# Altium schematic sheet Slot_1.SchDoc: =title_
size 594 x 420 mm; Date: 05/04/2023; CheckedBy: EG; GD; GK; MS; DrawnBy: M. Gąska; DocumentNumber: 4; SheetNumber: 4; SheetTotal: 5; Projet: DI/OT Crate; DivGrp: BE-CO; Title2: Slot 1; Designer: G.Daniluk; CreateDate: 05/04/2023; CheckedDate: 05/04/2023
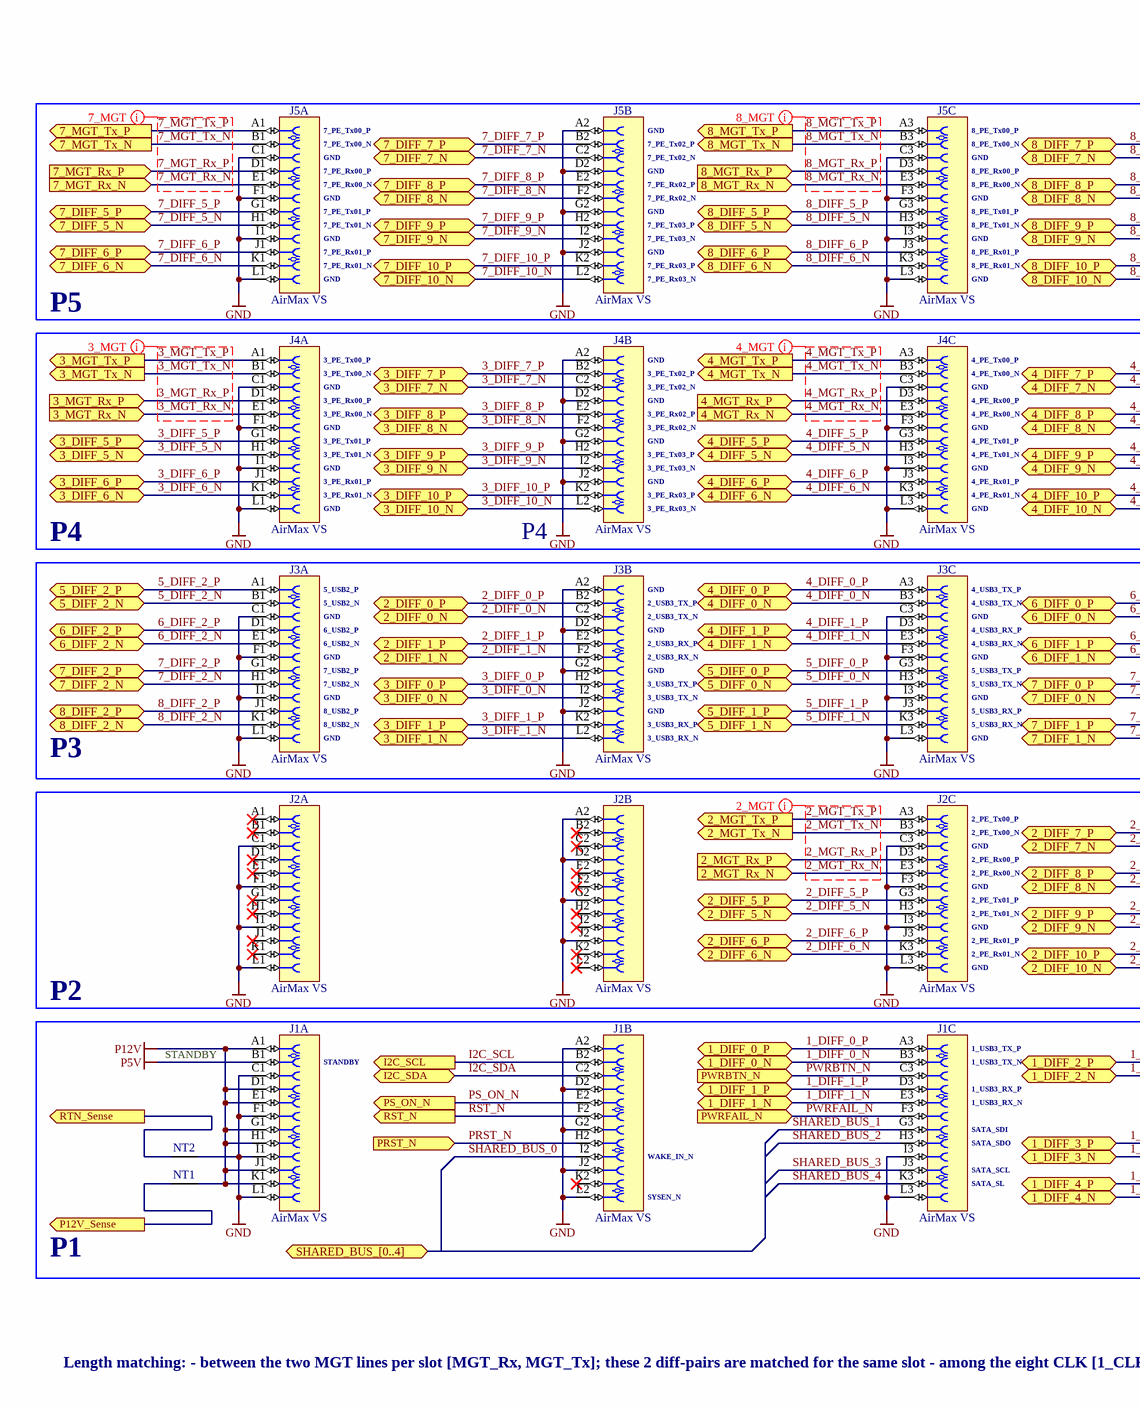
[diagram p0: Slot_1.SchDoc, left]
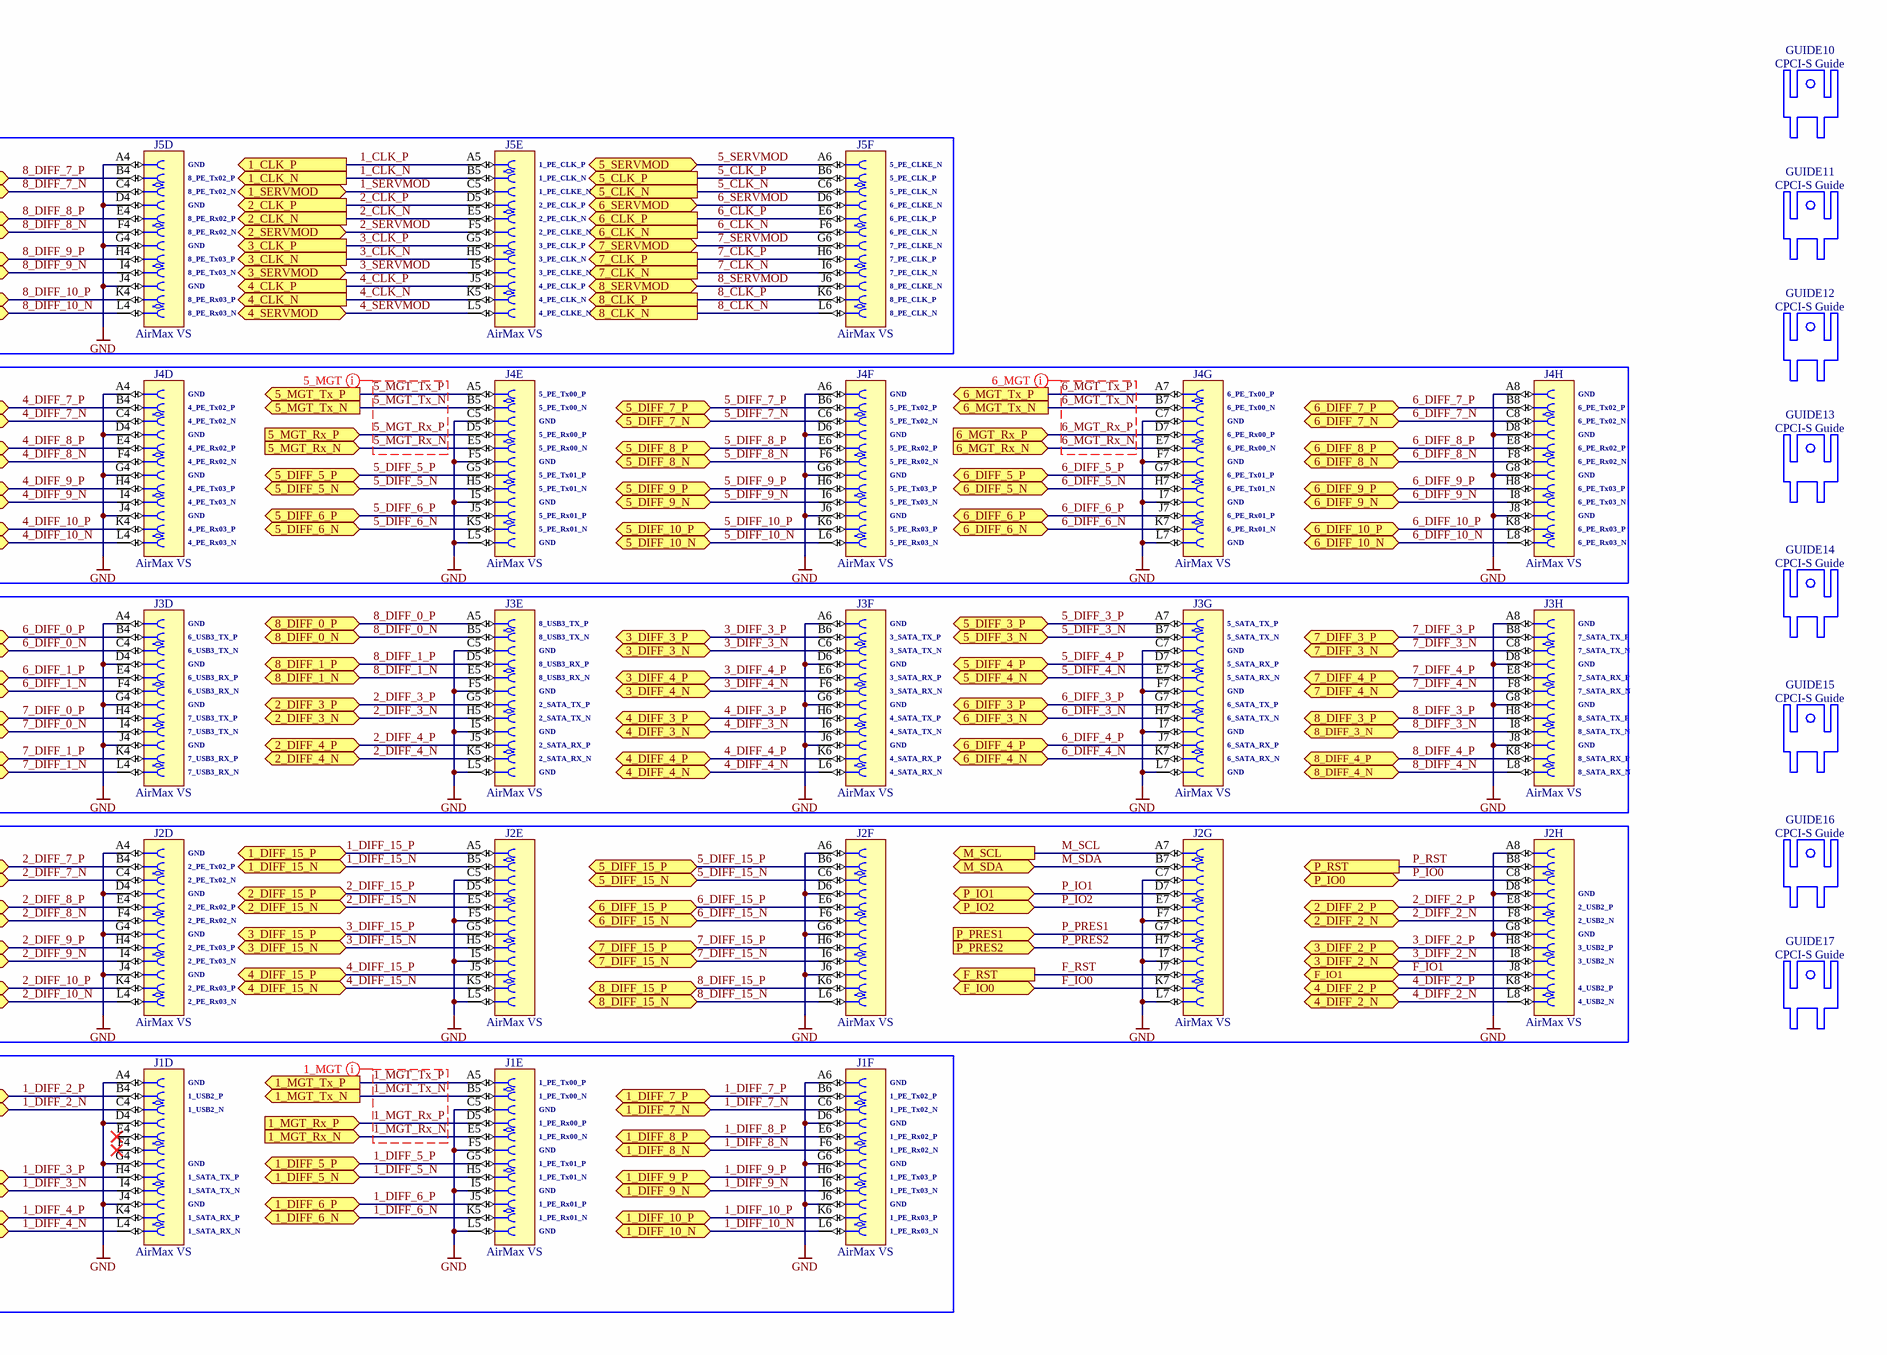
[diagram p1: Slot_1.SchDoc, right]

## Parts
GUIDE10  CPCI-S Guide  [EDA-04126-V1-0]
GUIDE11  CPCI-S Guide  [EDA-04126-V1-0]
GUIDE12  CPCI-S Guide  [EDA-04126-V1-0]
GUIDE13  CPCI-S Guide  [EDA-04126-V1-0]
GUIDE14  CPCI-S Guide  [EDA-04126-V1-0]
GUIDE15  CPCI-S Guide  [EDA-04126-V1-0]
GUIDE16  CPCI-S Guide  [EDA-04126-V1-0]
GUIDE17  CPCI-S Guide  [EDA-04126-V1-0]
J1  AirMax VS  [AMPHENOL_10052829-101LF]  (parts A,B,C,D,E,F of 6)
J2  AirMax VS  [AMPHENOL_10052842-101LF]  (parts A,B,C,D,E,F,G,H of 8)
J3  AirMax VS  [AMPHENOL_10052842-101LF]  (parts A,B,C,D,E,F,G,H of 8)
J4  AirMax VS  [AMPHENOL_10052842-101LF]  (parts A,B,C,D,E,F,G,H of 8)
J5  AirMax VS  [AMPHENOL_10052829-101LF]  (parts A,B,C,D,E,F of 6)
NT1  Net Tie  [Net Tie]  (value not drawn)  (net tie, no BOM)
NT2  Net Tie  [Net Tie]  (value not drawn)  (net tie, no BOM)

## Blocks framed on the sheet
P5: J5
P4: J4
P3: J3
P2: J2

## Ports
1_CLK_N (out), 1_CLK_P (out), 1_DIFF_0_N (bidir), 1_DIFF_0_P (bidir), 1_DIFF_1_N (bidir), 1_DIFF_1_P (bidir), 1_DIFF_2_N (bidir), 1_DIFF_2_P (bidir), 1_DIFF_3_N (bidir), 1_DIFF_3_P (bidir), 1_DIFF_4_N (bidir), 1_DIFF_4_P (bidir), 1_DIFF_5_N (bidir), 1_DIFF_5_P (bidir), 1_DIFF_6_N (bidir), 1_DIFF_6_P (bidir), 1_DIFF_7_N (bidir), 1_DIFF_7_P (bidir), 1_DIFF_8_N (bidir), 1_DIFF_8_P (bidir), 1_DIFF_9_N (bidir), 1_DIFF_9_P (bidir), 1_DIFF_10_N (bidir), 1_DIFF_10_P (bidir), 1_DIFF_15_N (bidir), 1_DIFF_15_P (bidir), 1_MGT_Rx_N (in), 1_MGT_Rx_P (in), 1_MGT_Tx_N (out), 1_MGT_Tx_P (out), 1_SERVMOD (bidir), 2_CLK_N (out), 2_CLK_P (out), 2_DIFF_0_N (bidir), 2_DIFF_0_P (bidir), 2_DIFF_1_N (bidir), 2_DIFF_1_P (bidir), 2_DIFF_2_N (bidir), 2_DIFF_2_P (bidir), 2_DIFF_3_N (bidir), 2_DIFF_3_P (bidir), 2_DIFF_4_N (bidir), 2_DIFF_4_P (bidir), 2_DIFF_5_N (bidir), 2_DIFF_5_P (bidir), 2_DIFF_6_N (bidir), 2_DIFF_6_P (bidir), 2_DIFF_7_N (bidir), 2_DIFF_7_P (bidir), 2_DIFF_8_N (bidir), 2_DIFF_8_P (bidir), 2_DIFF_9_N (bidir), 2_DIFF_9_P (bidir), 2_DIFF_10_N (bidir), 2_DIFF_10_P (bidir), 2_DIFF_15_N (bidir), 2_DIFF_15_P (bidir), 2_MGT_Rx_N (in), 2_MGT_Rx_P (in), 2_MGT_Tx_N (out), 2_MGT_Tx_P (out), 2_SERVMOD (bidir), 3_CLK_N (out), 3_CLK_P (out), 3_DIFF_0_N (bidir), 3_DIFF_0_P (bidir), 3_DIFF_1_N (bidir), 3_DIFF_1_P (bidir), 3_DIFF_2_N (bidir), 3_DIFF_2_P (bidir), 3_DIFF_3_N (bidir), 3_DIFF_3_P (bidir), 3_DIFF_4_N (bidir), 3_DIFF_4_P (bidir), 3_DIFF_5_N (bidir), 3_DIFF_5_P (bidir), 3_DIFF_6_N (bidir), 3_DIFF_6_P (bidir), 3_DIFF_7_N (bidir), 3_DIFF_7_P (bidir), 3_DIFF_8_N (bidir), 3_DIFF_8_P (bidir), 3_DIFF_9_N (bidir), 3_DIFF_9_P (bidir), 3_DIFF_10_N (bidir), 3_DIFF_10_P (bidir), 3_DIFF_15_N (bidir), 3_DIFF_15_P (bidir), 3_MGT_Rx_N (in), 3_MGT_Rx_P (in), 3_MGT_Tx_N (out), 3_MGT_Tx_P (out), 3_SERVMOD (bidir), 4_CLK_N (out), 4_CLK_P (out), 4_DIFF_0_N (bidir), 4_DIFF_0_P (bidir), 4_DIFF_1_N (bidir), 4_DIFF_1_P (bidir), 4_DIFF_2_N (bidir), 4_DIFF_2_P (bidir), 4_DIFF_3_N (bidir), 4_DIFF_3_P (bidir), 4_DIFF_4_N (bidir), 4_DIFF_4_P (bidir), 4_DIFF_5_N (bidir), 4_DIFF_5_P (bidir), 4_DIFF_6_N (bidir), 4_DIFF_6_P (bidir), 4_DIFF_7_N (bidir), 4_DIFF_7_P (bidir), 4_DIFF_8_N (bidir), 4_DIFF_8_P (bidir), 4_DIFF_9_N (bidir), 4_DIFF_9_P (bidir), 4_DIFF_10_N (bidir), 4_DIFF_10_P (bidir), 4_DIFF_15_N (bidir), 4_DIFF_15_P (bidir), 4_MGT_Rx_N (in), 4_MGT_Rx_P (in), 4_MGT_Tx_N (out), 4_MGT_Tx_P (out), 4_SERVMOD (bidir), 5_CLK_N (out), 5_CLK_P (out), 5_DIFF_0_N (bidir), 5_DIFF_0_P (bidir), 5_DIFF_1_N (bidir), 5_DIFF_1_P (bidir), 5_DIFF_2_N (bidir), 5_DIFF_2_P (bidir), 5_DIFF_3_N (bidir), 5_DIFF_3_P (bidir), 5_DIFF_4_N (bidir), 5_DIFF_4_P (bidir), 5_DIFF_5_N (bidir), 5_DIFF_5_P (bidir), 5_DIFF_6_N (bidir), 5_DIFF_6_P (bidir), 5_DIFF_7_N (bidir), 5_DIFF_7_P (bidir), 5_DIFF_8_N (bidir), 5_DIFF_8_P (bidir), 5_DIFF_9_N (bidir), 5_DIFF_9_P (bidir), 5_DIFF_10_N (bidir), 5_DIFF_10_P (bidir), 5_DIFF_15_N (bidir), 5_DIFF_15_P (bidir), 5_MGT_Rx_N (in), 5_MGT_Rx_P (in), 5_MGT_Tx_N (out), 5_MGT_Tx_P (out), 5_SERVMOD (bidir), 6_CLK_N (out), 6_CLK_P (out), 6_DIFF_0_N (bidir), 6_DIFF_0_P (bidir), 6_DIFF_1_N (bidir), 6_DIFF_1_P (bidir), 6_DIFF_2_N (bidir), 6_DIFF_2_P (bidir), 6_DIFF_3_N (bidir), 6_DIFF_3_P (bidir), 6_DIFF_4_N (bidir), 6_DIFF_4_P (bidir), 6_DIFF_5_N (bidir), 6_DIFF_5_P (bidir), 6_DIFF_6_N (bidir), 6_DIFF_6_P (bidir), 6_DIFF_7_N (bidir), 6_DIFF_7_P (bidir), 6_DIFF_8_N (bidir), 6_DIFF_8_P (bidir), 6_DIFF_9_N (bidir), 6_DIFF_9_P (bidir), 6_DIFF_10_N (bidir), 6_DIFF_10_P (bidir), 6_DIFF_15_N (bidir), 6_DIFF_15_P (bidir), 6_MGT_Rx_N (in), 6_MGT_Rx_P (in), 6_MGT_Tx_N (out), 6_MGT_Tx_P (out), 6_SERVMOD (bidir), 7_CLK_N (out), 7_CLK_P (out), 7_DIFF_0_N (bidir), 7_DIFF_0_P (bidir), 7_DIFF_1_N (bidir), 7_DIFF_1_P (bidir), 7_DIFF_2_N (bidir), 7_DIFF_2_P (bidir), 7_DIFF_3_N (bidir), 7_DIFF_3_P (bidir), 7_DIFF_4_N (bidir), 7_DIFF_4_P (bidir), 7_DIFF_5_N (bidir), 7_DIFF_5_P (bidir), 7_DIFF_6_N (bidir), 7_DIFF_6_P (bidir), 7_DIFF_7_N (bidir), 7_DIFF_7_P (bidir), 7_DIFF_8_N (bidir), 7_DIFF_8_P (bidir), 7_DIFF_9_N (bidir), 7_DIFF_9_P (bidir), 7_DIFF_10_N (bidir), 7_DIFF_10_P (bidir), 7_DIFF_15_N (bidir), 7_DIFF_15_P (bidir), 7_MGT_Rx_N (in), 7_MGT_Rx_P (in), 7_MGT_Tx_N (out), 7_MGT_Tx_P (out), 7_SERVMOD (bidir), 8_CLK_N (out), 8_CLK_P (out), 8_DIFF_0_N (bidir), 8_DIFF_0_P (bidir), 8_DIFF_1_N (bidir), 8_DIFF_1_P (bidir), 8_DIFF_2_N (bidir), 8_DIFF_2_P (bidir), 8_DIFF_3_N (bidir), 8_DIFF_3_P (bidir), 8_DIFF_4_N (bidir), 8_DIFF_4_P (bidir), 8_DIFF_5_N (bidir), 8_DIFF_5_P (bidir), 8_DIFF_6_N (bidir), 8_DIFF_6_P (bidir), 8_DIFF_7_N (bidir), 8_DIFF_7_P (bidir), 8_DIFF_8_N (bidir), 8_DIFF_8_P (bidir), 8_DIFF_9_N (bidir), 8_DIFF_9_P (bidir), 8_DIFF_10_N (bidir), 8_DIFF_10_P (bidir), 8_DIFF_15_N (bidir), 8_DIFF_15_P (bidir), 8_MGT_Rx_N (in), 8_MGT_Rx_P (in), 8_MGT_Tx_N (out), 8_MGT_Tx_P (out), 8_SERVMOD (bidir), F_IO0 (bidir), F_IO1 (bidir), F_RST (out), I2C_SCL (out), I2C_SDA (bidir), M_SCL (out), M_SDA (bidir), P12V_Sense (out), P_IO0 (bidir), P_IO1 (bidir), P_IO2 (bidir), P_PRES1 (in), P_PRES2 (in), P_RST (out), PRST_N (in), PS_ON_N (out), PWRBTN_N (in), PWRFAIL_N (in), RST_N (out), RTN_Sense (out), SHARED_BUS_[0..4] (bidir)

## Nets
GND: J1.A2 J1.A4 J1.A6 J1.C1 J1.C5 J1.D2 J1.D4 J1.D6 J1.F1 J1.F5 J1.G2 J1.G4 J1.G6 J1.I1 J1.I3 J1.I5 J1.J2 J1.J4 J1.J6 J1.L1 J1.L2 J1.L3 J1.L5 J2.A2 J2.A4 J2.A6 J2.A8 J2.C1 J2.C3 J2.C5 J2.C7 J2.D2 J2.D4 J2.D6 J2.D8 J2.F1 J2.F3 J2.F5 J2.F7 J2.G2 J2.G4 J2.G6 J2.G8 J2.I1 J2.I3 J2.I5 J2.I7 J2.J2 J2.J4 J2.J6 J2.L1 J2.L3 J2.L5 J2.L7 J3.A2 J3.A4 J3.A6 J3.A8 J3.C1 J3.C3 J3.C5 J3.C7 J3.D2 J3.D4 J3.D6 J3.D8 J3.F1 J3.F3 J3.F5 J3.F7 J3.G2 J3.G4 J3.G6 J3.G8 J3.I1 J3.I3 J3.I5 J3.I7 J3.J2 J3.J4 J3.J6 J3.J8 J3.L1 J3.L3 J3.L5 J3.L7 J4.A2 J4.A4 J4.A6 J4.A8 J4.C1 J4.C3 J4.C5 J4.C7 J4.D2 J4.D4 J4.D6 J4.D8 J4.F1 J4.F3 J4.F5 J4.F7 J4.G2 J4.G4 J4.G6 J4.G8 J4.I1 J4.I3 J4.I5 J4.I7 J4.J2 J4.J4 J4.J6 J4.J8 J4.L1 J4.L3 J4.L5 J4.L7 J5.A2 J5.A4 J5.C1 J5.C3 J5.D2 J5.D4 J5.F1 J5.F3 J5.G2 J5.G4 J5.I1 J5.I3 J5.J2 J5.J4 J5.L1 J5.L3 NT2.2
P5V: J1.B1
P12V: J1.A1 J1.D1 J1.E1 J1.G1 J1.H1 J1.J1 J1.K1 NT1.2
1_CLK_N: J5.B5 ; port 1_CLK_N
1_CLK_P: J5.A5 ; port 1_CLK_P
1_DIFF_0_N: J1.B3 ; port 1_DIFF_0_N
1_DIFF_0_P: J1.A3 ; port 1_DIFF_0_P
1_DIFF_1_N: J1.E3 ; port 1_DIFF_1_N
1_DIFF_1_P: J1.D3 ; port 1_DIFF_1_P
1_DIFF_2_N: J1.C4 ; port 1_DIFF_2_N
1_DIFF_2_P: J1.B4 ; port 1_DIFF_2_P
1_DIFF_3_N: J1.I4 ; port 1_DIFF_3_N
1_DIFF_3_P: J1.H4 ; port 1_DIFF_3_P
1_DIFF_4_N: J1.L4 ; port 1_DIFF_4_N
1_DIFF_4_P: J1.K4 ; port 1_DIFF_4_P
1_DIFF_5_N: J1.H5 ; port 1_DIFF_5_N
1_DIFF_5_P: J1.G5 ; port 1_DIFF_5_P
1_DIFF_6_N: J1.K5 ; port 1_DIFF_6_N
1_DIFF_6_P: J1.J5 ; port 1_DIFF_6_P
1_DIFF_7_N: J1.C6 ; port 1_DIFF_7_N
1_DIFF_7_P: J1.B6 ; port 1_DIFF_7_P
1_DIFF_8_N: J1.F6 ; port 1_DIFF_8_N
1_DIFF_8_P: J1.E6 ; port 1_DIFF_8_P
1_DIFF_9_N: J1.I6 ; port 1_DIFF_9_N
1_DIFF_9_P: J1.H6 ; port 1_DIFF_9_P
1_DIFF_10_N: J1.L6 ; port 1_DIFF_10_N
1_DIFF_10_P: J1.K6 ; port 1_DIFF_10_P
1_DIFF_15_N: J2.B5 ; port 1_DIFF_15_N
1_DIFF_15_P: J2.A5 ; port 1_DIFF_15_P
1_MGT_Rx_N: J1.E5 ; port 1_MGT_Rx_N
1_MGT_Rx_P: J1.D5 ; port 1_MGT_Rx_P
1_MGT_Tx_N: J1.B5 ; port 1_MGT_Tx_N
1_MGT_Tx_P: J1.A5 ; port 1_MGT_Tx_P
1_SERVMOD: J5.C5 ; port 1_SERVMOD
2_CLK_N: J5.E5 ; port 2_CLK_N
2_CLK_P: J5.D5 ; port 2_CLK_P
2_DIFF_0_N: J3.C2 ; port 2_DIFF_0_N
2_DIFF_0_P: J3.B2 ; port 2_DIFF_0_P
2_DIFF_1_N: J3.F2 ; port 2_DIFF_1_N
2_DIFF_1_P: J3.E2 ; port 2_DIFF_1_P
2_DIFF_2_N: J2.F8 ; port 2_DIFF_2_N
2_DIFF_2_P: J2.E8 ; port 2_DIFF_2_P
2_DIFF_3_N: J3.H5 ; port 2_DIFF_3_N
2_DIFF_3_P: J3.G5 ; port 2_DIFF_3_P
2_DIFF_4_N: J3.K5 ; port 2_DIFF_4_N
2_DIFF_4_P: J3.J5 ; port 2_DIFF_4_P
2_DIFF_5_N: J2.H3 ; port 2_DIFF_5_N
2_DIFF_5_P: J2.G3 ; port 2_DIFF_5_P
2_DIFF_6_N: J2.K3 ; port 2_DIFF_6_N
2_DIFF_6_P: J2.J3 ; port 2_DIFF_6_P
2_DIFF_7_N: J2.C4 ; port 2_DIFF_7_N
2_DIFF_7_P: J2.B4 ; port 2_DIFF_7_P
2_DIFF_8_N: J2.F4 ; port 2_DIFF_8_N
2_DIFF_8_P: J2.E4 ; port 2_DIFF_8_P
2_DIFF_9_N: J2.I4 ; port 2_DIFF_9_N
2_DIFF_9_P: J2.H4 ; port 2_DIFF_9_P
2_DIFF_10_N: J2.L4 ; port 2_DIFF_10_N
2_DIFF_10_P: J2.K4 ; port 2_DIFF_10_P
2_DIFF_15_N: J2.E5 ; port 2_DIFF_15_N
2_DIFF_15_P: J2.D5 ; port 2_DIFF_15_P
2_MGT_Rx_N: J2.E3 ; port 2_MGT_Rx_N
2_MGT_Rx_P: J2.D3 ; port 2_MGT_Rx_P
2_MGT_Tx_N: J2.B3 ; port 2_MGT_Tx_N
2_MGT_Tx_P: J2.A3 ; port 2_MGT_Tx_P
2_SERVMOD: J5.F5 ; port 2_SERVMOD
3_CLK_N: J5.H5 ; port 3_CLK_N
3_CLK_P: J5.G5 ; port 3_CLK_P
3_DIFF_0_N: J3.I2 ; port 3_DIFF_0_N
3_DIFF_0_P: J3.H2 ; port 3_DIFF_0_P
3_DIFF_1_N: J3.L2 ; port 3_DIFF_1_N
3_DIFF_1_P: J3.K2 ; port 3_DIFF_1_P
3_DIFF_2_N: J2.I8 ; port 3_DIFF_2_N
3_DIFF_2_P: J2.H8 ; port 3_DIFF_2_P
3_DIFF_3_N: J3.C6 ; port 3_DIFF_3_N
3_DIFF_3_P: J3.B6 ; port 3_DIFF_3_P
3_DIFF_4_N: J3.F6 ; port 3_DIFF_4_N
3_DIFF_4_P: J3.E6 ; port 3_DIFF_4_P
3_DIFF_5_N: J4.H1 ; port 3_DIFF_5_N
3_DIFF_5_P: J4.G1 ; port 3_DIFF_5_P
3_DIFF_6_N: J4.K1 ; port 3_DIFF_6_N
3_DIFF_6_P: J4.J1 ; port 3_DIFF_6_P
3_DIFF_7_N: J4.C2 ; port 3_DIFF_7_N
3_DIFF_7_P: J4.B2 ; port 3_DIFF_7_P
3_DIFF_8_N: J4.F2 ; port 3_DIFF_8_N
3_DIFF_8_P: J4.E2 ; port 3_DIFF_8_P
3_DIFF_9_N: J4.I2 ; port 3_DIFF_9_N
3_DIFF_9_P: J4.H2 ; port 3_DIFF_9_P
3_DIFF_10_N: J4.L2 ; port 3_DIFF_10_N
3_DIFF_10_P: J4.K2 ; port 3_DIFF_10_P
3_DIFF_15_N: J2.H5 ; port 3_DIFF_15_N
3_DIFF_15_P: J2.G5 ; port 3_DIFF_15_P
3_MGT_Rx_N: J4.E1 ; port 3_MGT_Rx_N
3_MGT_Rx_P: J4.D1 ; port 3_MGT_Rx_P
3_MGT_Tx_N: J4.B1 ; port 3_MGT_Tx_N
3_MGT_Tx_P: J4.A1 ; port 3_MGT_Tx_P
3_SERVMOD: J5.I5 ; port 3_SERVMOD
4_CLK_N: J5.K5 ; port 4_CLK_N
4_CLK_P: J5.J5 ; port 4_CLK_P
4_DIFF_0_N: J3.B3 ; port 4_DIFF_0_N
4_DIFF_0_P: J3.A3 ; port 4_DIFF_0_P
4_DIFF_1_N: J3.E3 ; port 4_DIFF_1_N
4_DIFF_1_P: J3.D3 ; port 4_DIFF_1_P
4_DIFF_2_N: J2.L8 ; port 4_DIFF_2_N
4_DIFF_2_P: J2.K8 ; port 4_DIFF_2_P
4_DIFF_3_N: J3.I6 ; port 4_DIFF_3_N
4_DIFF_3_P: J3.H6 ; port 4_DIFF_3_P
4_DIFF_4_N: J3.L6 ; port 4_DIFF_4_N
4_DIFF_4_P: J3.K6 ; port 4_DIFF_4_P
4_DIFF_5_N: J4.H3 ; port 4_DIFF_5_N
4_DIFF_5_P: J4.G3 ; port 4_DIFF_5_P
4_DIFF_6_N: J4.K3 ; port 4_DIFF_6_N
4_DIFF_6_P: J4.J3 ; port 4_DIFF_6_P
4_DIFF_7_N: J4.C4 ; port 4_DIFF_7_N
4_DIFF_7_P: J4.B4 ; port 4_DIFF_7_P
4_DIFF_8_N: J4.F4 ; port 4_DIFF_8_N
4_DIFF_8_P: J4.E4 ; port 4_DIFF_8_P
4_DIFF_9_N: J4.I4 ; port 4_DIFF_9_N
4_DIFF_9_P: J4.H4 ; port 4_DIFF_9_P
4_DIFF_10_N: J4.L4 ; port 4_DIFF_10_N
4_DIFF_10_P: J4.K4 ; port 4_DIFF_10_P
4_DIFF_15_N: J2.K5 ; port 4_DIFF_15_N
4_DIFF_15_P: J2.J5 ; port 4_DIFF_15_P
4_MGT_Rx_N: J4.E3 ; port 4_MGT_Rx_N
4_MGT_Rx_P: J4.D3 ; port 4_MGT_Rx_P
4_MGT_Tx_N: J4.B3 ; port 4_MGT_Tx_N
4_MGT_Tx_P: J4.A3 ; port 4_MGT_Tx_P
4_SERVMOD: J5.L5 ; port 4_SERVMOD
5_CLK_N: J5.C6 ; port 5_CLK_N
5_CLK_P: J5.B6 ; port 5_CLK_P
5_DIFF_0_N: J3.H3 ; port 5_DIFF_0_N
5_DIFF_0_P: J3.G3 ; port 5_DIFF_0_P
5_DIFF_1_N: J3.K3 ; port 5_DIFF_1_N
5_DIFF_1_P: J3.J3 ; port 5_DIFF_1_P
5_DIFF_2_N: J3.B1 ; port 5_DIFF_2_N
5_DIFF_2_P: J3.A1 ; port 5_DIFF_2_P
5_DIFF_3_N: J3.B7 ; port 5_DIFF_3_N
5_DIFF_3_P: J3.A7 ; port 5_DIFF_3_P
5_DIFF_4_N: J3.E7 ; port 5_DIFF_4_N
5_DIFF_4_P: J3.D7 ; port 5_DIFF_4_P
5_DIFF_5_N: J4.H5 ; port 5_DIFF_5_N
5_DIFF_5_P: J4.G5 ; port 5_DIFF_5_P
5_DIFF_6_N: J4.K5 ; port 5_DIFF_6_N
5_DIFF_6_P: J4.J5 ; port 5_DIFF_6_P
5_DIFF_7_N: J4.C6 ; port 5_DIFF_7_N
5_DIFF_7_P: J4.B6 ; port 5_DIFF_7_P
5_DIFF_8_N: J4.F6 ; port 5_DIFF_8_N
5_DIFF_8_P: J4.E6 ; port 5_DIFF_8_P
5_DIFF_9_N: J4.I6 ; port 5_DIFF_9_N
5_DIFF_9_P: J4.H6 ; port 5_DIFF_9_P
5_DIFF_10_N: J4.L6 ; port 5_DIFF_10_N
5_DIFF_10_P: J4.K6 ; port 5_DIFF_10_P
5_DIFF_15_N: J2.C6 ; port 5_DIFF_15_N
5_DIFF_15_P: J2.B6 ; port 5_DIFF_15_P
5_MGT_Rx_N: J4.E5 ; port 5_MGT_Rx_N
5_MGT_Rx_P: J4.D5 ; port 5_MGT_Rx_P
5_MGT_Tx_N: J4.B5 ; port 5_MGT_Tx_N
5_MGT_Tx_P: J4.A5 ; port 5_MGT_Tx_P
5_SERVMOD: J5.A6 ; port 5_SERVMOD
6_CLK_N: J5.F6 ; port 6_CLK_N
6_CLK_P: J5.E6 ; port 6_CLK_P
6_DIFF_0_N: J3.C4 ; port 6_DIFF_0_N
6_DIFF_0_P: J3.B4 ; port 6_DIFF_0_P
6_DIFF_1_N: J3.F4 ; port 6_DIFF_1_N
6_DIFF_1_P: J3.E4 ; port 6_DIFF_1_P
6_DIFF_2_N: J3.E1 ; port 6_DIFF_2_N
6_DIFF_2_P: J3.D1 ; port 6_DIFF_2_P
6_DIFF_3_N: J3.H7 ; port 6_DIFF_3_N
6_DIFF_3_P: J3.G7 ; port 6_DIFF_3_P
6_DIFF_4_N: J3.K7 ; port 6_DIFF_4_N
6_DIFF_4_P: J3.J7 ; port 6_DIFF_4_P
6_DIFF_5_N: J4.H7 ; port 6_DIFF_5_N
6_DIFF_5_P: J4.G7 ; port 6_DIFF_5_P
6_DIFF_6_N: J4.K7 ; port 6_DIFF_6_N
6_DIFF_6_P: J4.J7 ; port 6_DIFF_6_P
6_DIFF_7_N: J4.C8 ; port 6_DIFF_7_N
6_DIFF_7_P: J4.B8 ; port 6_DIFF_7_P
6_DIFF_8_N: J4.F8 ; port 6_DIFF_8_N
6_DIFF_8_P: J4.E8 ; port 6_DIFF_8_P
6_DIFF_9_N: J4.I8 ; port 6_DIFF_9_N
6_DIFF_9_P: J4.H8 ; port 6_DIFF_9_P
6_DIFF_10_N: J4.L8 ; port 6_DIFF_10_N
6_DIFF_10_P: J4.K8 ; port 6_DIFF_10_P
6_DIFF_15_N: J2.F6 ; port 6_DIFF_15_N
6_DIFF_15_P: J2.E6 ; port 6_DIFF_15_P
6_MGT_Rx_N: J4.E7 ; port 6_MGT_Rx_N
6_MGT_Rx_P: J4.D7 ; port 6_MGT_Rx_P
6_MGT_Tx_N: J4.B7 ; port 6_MGT_Tx_N
6_MGT_Tx_P: J4.A7 ; port 6_MGT_Tx_P
6_SERVMOD: J5.D6 ; port 6_SERVMOD
7_CLK_N: J5.I6 ; port 7_CLK_N
7_CLK_P: J5.H6 ; port 7_CLK_P
7_DIFF_0_N: J3.I4 ; port 7_DIFF_0_N
7_DIFF_0_P: J3.H4 ; port 7_DIFF_0_P
7_DIFF_1_N: J3.L4 ; port 7_DIFF_1_N
7_DIFF_1_P: J3.K4 ; port 7_DIFF_1_P
7_DIFF_2_N: J3.H1 ; port 7_DIFF_2_N
7_DIFF_2_P: J3.G1 ; port 7_DIFF_2_P
7_DIFF_3_N: J3.C8 ; port 7_DIFF_3_N
7_DIFF_3_P: J3.B8 ; port 7_DIFF_3_P
7_DIFF_4_N: J3.F8 ; port 7_DIFF_4_N
7_DIFF_4_P: J3.E8 ; port 7_DIFF_4_P
7_DIFF_5_N: J5.H1 ; port 7_DIFF_5_N
7_DIFF_5_P: J5.G1 ; port 7_DIFF_5_P
7_DIFF_6_N: J5.K1 ; port 7_DIFF_6_N
7_DIFF_6_P: J5.J1 ; port 7_DIFF_6_P
7_DIFF_7_N: J5.C2 ; port 7_DIFF_7_N
7_DIFF_7_P: J5.B2 ; port 7_DIFF_7_P
7_DIFF_8_N: J5.F2 ; port 7_DIFF_8_N
7_DIFF_8_P: J5.E2 ; port 7_DIFF_8_P
7_DIFF_9_N: J5.I2 ; port 7_DIFF_9_N
7_DIFF_9_P: J5.H2 ; port 7_DIFF_9_P
7_DIFF_10_N: J5.L2 ; port 7_DIFF_10_N
7_DIFF_10_P: J5.K2 ; port 7_DIFF_10_P
7_DIFF_15_N: J2.I6 ; port 7_DIFF_15_N
7_DIFF_15_P: J2.H6 ; port 7_DIFF_15_P
7_MGT_Rx_N: J5.E1 ; port 7_MGT_Rx_N
7_MGT_Rx_P: J5.D1 ; port 7_MGT_Rx_P
7_MGT_Tx_N: J5.B1 ; port 7_MGT_Tx_N
7_MGT_Tx_P: J5.A1 ; port 7_MGT_Tx_P
7_SERVMOD: J5.G6 ; port 7_SERVMOD
8_CLK_N: J5.L6 ; port 8_CLK_N
8_CLK_P: J5.K6 ; port 8_CLK_P
8_DIFF_0_N: J3.B5 ; port 8_DIFF_0_N
8_DIFF_0_P: J3.A5 ; port 8_DIFF_0_P
8_DIFF_1_N: J3.E5 ; port 8_DIFF_1_N
8_DIFF_1_P: J3.D5 ; port 8_DIFF_1_P
8_DIFF_2_N: J3.K1 ; port 8_DIFF_2_N
8_DIFF_2_P: J3.J1 ; port 8_DIFF_2_P
8_DIFF_3_N: J3.I8 ; port 8_DIFF_3_N
8_DIFF_3_P: J3.H8 ; port 8_DIFF_3_P
8_DIFF_4_N: J3.L8 ; port 8_DIFF_4_N
8_DIFF_4_P: J3.K8 ; port 8_DIFF_4_P
8_DIFF_5_N: J5.H3 ; port 8_DIFF_5_N
8_DIFF_5_P: J5.G3 ; port 8_DIFF_5_P
8_DIFF_6_N: J5.K3 ; port 8_DIFF_6_N
8_DIFF_6_P: J5.J3 ; port 8_DIFF_6_P
8_DIFF_7_N: J5.C4 ; port 8_DIFF_7_N
8_DIFF_7_P: J5.B4 ; port 8_DIFF_7_P
8_DIFF_8_N: J5.F4 ; port 8_DIFF_8_N
8_DIFF_8_P: J5.E4 ; port 8_DIFF_8_P
8_DIFF_9_N: J5.I4 ; port 8_DIFF_9_N
8_DIFF_9_P: J5.H4 ; port 8_DIFF_9_P
8_DIFF_10_N: J5.L4 ; port 8_DIFF_10_N
8_DIFF_10_P: J5.K4 ; port 8_DIFF_10_P
8_DIFF_15_N: J2.L6 ; port 8_DIFF_15_N
8_DIFF_15_P: J2.K6 ; port 8_DIFF_15_P
8_MGT_Rx_N: J5.E3 ; port 8_MGT_Rx_N
8_MGT_Rx_P: J5.D3 ; port 8_MGT_Rx_P
8_MGT_Tx_N: J5.B3 ; port 8_MGT_Tx_N
8_MGT_Tx_P: J5.A3 ; port 8_MGT_Tx_P
8_SERVMOD: J5.J6 ; port 8_SERVMOD
F_IO0: J2.K7 ; port F_IO0
F_IO1: J2.J8 ; port F_IO1
F_RST: J2.J7 ; port F_RST
I2C_SCL: J1.B2 ; port I2C_SCL
I2C_SDA: J1.C2 ; port I2C_SDA
M_SCL: J2.A7 ; port M_SCL
M_SDA: J2.B7 ; port M_SDA
P12V_Sense: NT1.1 ; port P12V_Sense
P_IO0: J2.C8 ; port P_IO0
P_IO1: J2.D7 ; port P_IO1
P_IO2: J2.E7 ; port P_IO2
P_PRES1: J2.G7 ; port P_PRES1
P_PRES2: J2.H7 ; port P_PRES2
P_RST: J2.B8 ; port P_RST
PRST_N: J1.H2 ; port PRST_N
PS_ON_N: J1.E2 ; port PS_ON_N
PWRBTN_N: J1.C3 ; port PWRBTN_N
PWRFAIL_N: J1.F3 ; port PWRFAIL_N
RST_N: J1.F2 ; port RST_N
RTN_Sense: NT2.1 ; port RTN_Sense
SHARED_BUS_0: J1.I2
SHARED_BUS_1: J1.G3
SHARED_BUS_2: J1.H3
SHARED_BUS_3: J1.J3
SHARED_BUS_4: J1.K3

Not connected (* = marked no-connect by the designer): GUIDE10 1; GUIDE11 1; GUIDE12 1; GUIDE13 1; GUIDE14 1; GUIDE15 1; GUIDE16 1; GUIDE17 1; J1 E4* F4* K2*; J2 A1* B1* B2* C2* D1* E1* E2* F2* G1* H1* H2* I2* J1* K1* K2* L2*

## Layout directives
net class 7_MGT: 7_MGT_Rx_N, 7_MGT_Rx_P, 7_MGT_Tx_N, 7_MGT_Tx_P
net class 3_MGT: 3_MGT_Rx_N, 3_MGT_Rx_P, 3_MGT_Tx_N, 3_MGT_Tx_P
net class 8_MGT: 8_MGT_Rx_N, 8_MGT_Rx_P, 8_MGT_Tx_N, 8_MGT_Tx_P
net class 4_MGT: 4_MGT_Rx_N, 4_MGT_Rx_P, 4_MGT_Tx_N, 4_MGT_Tx_P
net class 2_MGT: 2_MGT_Rx_N, 2_MGT_Rx_P, 2_MGT_Tx_N, 2_MGT_Tx_P
net class 1_MGT: 1_MGT_Rx_N, 1_MGT_Rx_P, 1_MGT_Tx_N, 1_MGT_Tx_P
net class 5_MGT: 5_MGT_Rx_N, 5_MGT_Rx_P, 5_MGT_Tx_N, 5_MGT_Tx_P
net class 6_MGT: 6_MGT_Rx_N, 6_MGT_Rx_P, 6_MGT_Tx_N, 6_MGT_Tx_P

## Notes on the sheet
- (near J5) 7_PE_Tx00_P
- (near J5) 7_PE_Tx00_N
- (near J5) 7_PE_Rx00_P
- (near J5) GND
- (near J5) 7_PE_Tx02_P
- (near J5) 7_PE_Tx02_N
- (near J5) 8_PE_Tx00_P
- (near J5) 8_PE_Tx00_N
- (near J5) 8_PE_Rx00_P
- (near J5) 8_PE_Tx02_P
- (near J5) 8_PE_Tx02_N
- (near J5) 1_PE_CLKE_N
- (near J5) 1_PE_CLK_P
- (near J5) 1_PE_CLK_N
- (near J5) 2_PE_CLK_P
- (near J5) 5_PE_CLKE_N
- (near J5) 6_PE_CLKE_N
- (near J5) 5_PE_CLK_P
- (near J5) 5_PE_CLK_N
- (near J5) 7_PE_Tx01_P
- (near J5) 7_PE_Tx01_N
- (near J5) 7_PE_Rx00_N
- (near J5) 7_PE_Rx02_P
- (near J5) 7_PE_Rx02_N
- (near J5) 7_PE_Tx03_P
- (near J5) 7_PE_Tx03_N
- (near J5) 8_PE_Tx01_N
- (near J5) 8_PE_Tx01_P
- (near J5) 8_PE_Rx00_N
- (near J5) 8_PE_Rx02_P
- (near J5) 8_PE_Rx02_N
- (near J5) 8_PE_Tx03_P
- (near J5) 8_PE_Tx03_N
- (near J5) 2_PE_CLKE_N
- (near J5) 3_PE_CLKE_N
- (near J5) 2_PE_CLK_N
- (near J5) 3_PE_CLK_P
- (near J5) 3_PE_CLK_N
- (near J5) 7_PE_CLKE_N
- (near J5) 6_PE_CLK_P
- (near J5) 6_PE_CLK_N
- (near J5) 7_PE_CLK_P
- (near J5) 7_PE_CLK_N
- (near J5) 7_PE_Rx01_P
- (near J5) 7_PE_Rx01_N
- (near J5) 7_PE_Rx03_P
- (near J5) 7_PE_Rx03_N
- (near J5) 8_PE_Rx01_P
- (near J5) 8_PE_Rx01_N
- (near J5) 8_PE_Rx03_P
- (near J5) 8_PE_Rx03_N
- (near J5) 4_PE_CLKE_N
- (near J5) 4_PE_CLK_P
- (near J5) 4_PE_CLK_N
- (near J5) 8_PE_CLKE_N
- (near J5) 8_PE_CLK_P
- (near J5) 8_PE_CLK_N
- (near J4) 3_PE_Tx00_P
- (near J4) 3_PE_Tx00_N
- (near J4) 3_PE_Tx02_P
- (near J4) GND
- (near J4) 4_PE_Tx00_P
- (near J4) 4_PE_Tx00_N
- (near J4) 4_PE_Tx02_P
- (near J4) 5_PE_Tx00_P
- (near J4) 5_PE_Tx00_N
- (near J4) 5_PE_Tx02_P
- (near J4) 6_PE_Tx00_P
- (near J4) 6_PE_Tx00_N
- (near J4) 6_PE_Tx02_P
- (near J4) 3_PE_Tx01_P
- (near J4) 3_PE_Rx00_P
- (near J4) 3_PE_Rx00_N
- (near J4) 3_PE_Tx02_N
- (near J4) 3_PE_Rx02_P
- (near J4) 3_PE_Rx02_N
- (near J4) 4_PE_Tx01_P
- (near J4) 4_PE_Rx00_P
- (near J4) 4_PE_Rx00_N
- (near J4) 4_PE_Tx02_N
- (near J4) 4_PE_Rx02_P
- (near J4) 4_PE_Rx02_N
- (near J4) 5_PE_Tx01_P
- (near J4) 5_PE_Rx00_P
- (near J4) 5_PE_Rx00_N
- (near J4) 5_PE_Tx02_N
- (near J4) 5_PE_Rx02_P
- (near J4) 5_PE_Rx02_N
- (near J4) 6_PE_Tx01_P
- (near J4) 6_PE_Rx00_P
- (near J4) 6_PE_Rx00_N
- (near J4) 6_PE_Tx02_N
- (near J4) 6_PE_Rx02_P
- (near J4) 6_PE_Rx02_N
- (near J4) 3_PE_Tx01_N
- (near J4) 3_PE_Rx01_P
- (near J4) 3_PE_Rx01_N
- (near J4) 3_PE_Tx03_P
- (near J4) 3_PE_Tx03_N
- (near J4) 3_PE_Rx03_P
- (near J4) 3_PE_Rx03_N
- (near J4) 4_PE_Tx01_N
- (near J4) 4_PE_Rx01_P
- (near J4) 4_PE_Rx01_N
- (near J4) 4_PE_Tx03_P
- (near J4) 4_PE_Tx03_N
- (near J4) 4_PE_Rx03_P
- (near J4) 4_PE_Rx03_N
- (near J4) 5_PE_Tx01_N
- (near J4) 5_PE_Rx01_N
- (near J4) 5_PE_Rx01_P
- (near J4) 5_PE_Tx03_P
- (near J4) 5_PE_Tx03_N
- (near J4) 5_PE_Rx03_P
- (near J4) 5_PE_Rx03_N
- (near J4) 6_PE_Tx01_N
- (near J4) 6_PE_Rx01_P
- (near J4) 6_PE_Rx01_N
- (near J4) 6_PE_Tx03_P
- (near J4) 6_PE_Tx03_N
- (near J4) 6_PE_Rx03_N
- (near J4) 6_PE_Rx03_P
- P4
- (near J3) 5_USB2_P
- (near J3) 5_USB2_N
- (near J3) 6_USB2_P
- (near J3) 6_USB2_N
- (near J3) GND
- (near J3) 2_USB3_TX_P
- (near J3) 2_USB3_TX_N
- (near J3) 2_USB3_RX_P
- (near J3) 4_USB3_TX_P
- (near J3) 4_USB3_TX_N
- (near J3) 4_USB3_RX_P
- (near J3) 4_USB3_RX_N
- (near J3) 6_USB3_TX_P
- (near J3) 6_USB3_TX_N
- (near J3) 6_USB3_RX_P
- (near J3) 8_USB3_TX_P
- (near J3) 8_USB3_TX_N
- (near J3) 8_USB3_RX_P
- (near J3) 8_USB3_RX_N
- (near J3) 3_SATA_TX_P
- (near J3) 3_SATA_TX_N
- (near J3) 3_SATA_RX_P
- (near J3) 5_SATA_TX_P
- (near J3) 5_SATA_TX_N
- (near J3) 5_SATA_RX_P
- (near J3) 5_SATA_RX_N
- (near J3) 7_SATA_TX_P
- (near J3) 7_SATA_TX_N
- (near J3) 7_SATA_RX_P
- (near J3) 7_USB2_P
- (near J3) 7_USB2_N
- (near J3) 8_USB2_P
- (near J3) 3_USB3_TX_P
- (near J3) 3_USB3_TX_N
- (near J3) 2_USB3_RX_N
- (near J3) 5_USB3_TX_P
- (near J3) 5_USB3_TX_N
- (near J3) 5_USB3_RX_P
- (near J3) 7_USB3_TX_P
- (near J3) 7_USB3_TX_N
- (near J3) 6_USB3_RX_N
- (near J3) 2_SATA_TX_P
- (near J3) 2_SATA_TX_N
- (near J3) 2_SATA_RX_P
- (near J3) 4_SATA_TX_P
- (near J3) 4_SATA_TX_N
- (near J3) 3_SATA_RX_N
- (near J3) 6_SATA_TX_P
- (near J3) 6_SATA_TX_N
- (near J3) 6_SATA_RX_P
- (near J3) 8_SATA_TX_P
- (near J3) 8_SATA_TX_N
- (near J3) 7_SATA_RX_N
- (near J3) 8_USB2_N
- (near J3) 3_USB3_RX_P
- (near J3) 3_USB3_RX_N
- (near J3) 5_USB3_RX_N
- (near J3) 7_USB3_RX_P
- (near J3) 7_USB3_RX_N
- (near J3) 2_SATA_RX_N
- (near J3) 4_SATA_RX_P
- (near J3) 4_SATA_RX_N
- (near J3) 6_SATA_RX_N
- (near J3) 8_SATA_RX_P
- (near J3) 8_SATA_RX_N
- (near J2) 2_PE_Tx00_P
- (near J2) 2_PE_Tx00_N
- (near J2) GND
- (near J2) 2_PE_Tx02_P
- (near J2) 2_PE_Tx02_N
- (near J2) 2_PE_Tx01_N
- (near J2) 2_PE_Tx01_P
- (near J2) 2_PE_Rx00_P
- (near J2) 2_PE_Rx00_N
- (near J2) 2_PE_Rx02_P
- (near J2) 2_PE_Rx02_N
- (near J2) 2_PE_Tx03_P
- (near J2) 3_USB2_P
- (near J2) 2_USB2_N
- (near J2) 2_USB2_P
- (near J2) 2_PE_Rx01_P
- (near J2) 2_PE_Rx01_N
- (near J2) 2_PE_Tx03_N
- (near J2) 2_PE_Rx03_P
- (near J2) 2_PE_Rx03_N
- (near J2) 4_USB2_N
- (near J2) 4_USB2_P
- (near J2) 3_USB2_N
- (near J1) 1_USB3_TX_P
- (near J1) GND
- (near J1) 1_PE_Tx00_P
- STANDBY
- (near J1) STANDBY
- (near J1) 1_USB3_RX_N
- (near J1) 1_USB3_RX_P
- (near J1) 1_USB3_TX_N
- (near J1) 1_USB2_N
- (near J1) 1_USB2_P
- (near J1) 1_PE_Tx00_N
- (near J1) 1_PE_Rx00_P
- (near J1) 1_PE_Rx00_N
- (near J1) 1_PE_Rx02_N
- (near J1) 1_PE_Rx02_P
- (near J1) 1_PE_Tx02_N
- (near J1) 1_PE_Tx02_P
- (near J1) WAKE_IN_N
- (near J1) SATA_SDI
- (near J1) SATA_SDO
- (near J1) SATA_SCL
- (near J1) SATA_SL
- (near J1) 1_SATA_RX_P
- (near J1) 1_SATA_TX_N
- (near J1) 1_SATA_TX_P
- (near J1) 1_PE_Rx01_N
- (near J1) 1_PE_Rx01_P
- (near J1) 1_PE_Tx01_N
- (near J1) 1_PE_Tx01_P
- (near J1) 1_PE_Rx03_P
- (near J1) 1_PE_Tx03_N
- (near J1) 1_PE_Tx03_P
- (near J1) SYSEN_N
- (near J1) 1_SATA_RX_N
- (near J1) 1_PE_Rx03_N
- P1
- Length matching:
  - between the two MGT lines per slot [MGT_Rx, MGT_Tx]; these 2 diff-pairs are matched for the same slot
  - among the eight CLK [1_CLK..8_CLK]; these 8 diff-pairs are length-matched.
  All n_MGT_Tx/n_MGT_Rx signals mast have controlled differential impedance of 100 Ohm
- Project/Equipment
- Document
- File
- Designer
- Drawn by
- Check.by
- Last Mod.
- Copyright WUT ISE 2024.
  This documentation describes Open Hardware and is licensed under the CERN OHL-W v.2.0. You may redistribute and modify this documentation under the terms of the CERN OHL-W v.2.0. (http://ohwr.org/CERNOHL). This documentation is distributed WITHOUT ANY EXPRESS OR IMPLIED WARRANTY, INCLUDING OF MERCHANTABILITY, SATISFACTORY QUALITY AND FITNESS FOR A PARTICULAR PURPOSE. Please see the CERN OHL v.2.0 for applicable conditions.
- Contact
- Print Date
- Sheet
- Size
- A2
- of
- Rev

## Library data of the parts
GUIDE10-GUIDE17 = EDA-04126-V1-0: PICMG CompactPCI Serial Backplane Guide Element; Manufacturer: CERN; PressFit: No; Part Number: EDA-04126-V1-0; Component Kind: Standard; Component Type: Standard; Pin Count: 2; PackageDescription: PICMG CompactPCI Serial Backplane Guide Element; Mounted: Yes; Socket: No; SMD: No; Sense: No; Status: None; Value: CPCI-S Guide; Part Description: PICMG CompactPCI Serial Backplane Guide Element; Manufacturer Part Number: EDA-04126-V1-0; ComponentHeight: 32mm; HelpURL: \\cern.ch\dfs\Applications\Altium\Datasheets\EDA-04126-V1-0.pdf; ComponentLink1URL: https://edms.cern.ch/nav/EDA-04126-V1-0; ComponentLink1Description: EDMS Link; Author: CERN DEM BC; CreateDate: 24.09.2019; LatestRevisionDate: 24.09.2019
J1 J5 = AMPHENOL_10052829-101LF: 72 Contacts Receptacle, 6 Columns, 4 Pairs per Column; Part Description: 72 Contacts, 2mm Pitch, 6 Columns, 4 Pairs per Column, Vertical Receptacle; Part Number: AMPHENOL_10052829-101LF; Component Kind: Standard; Component Type: Standard; Pin Count: 72; Family: AirMax VS; Mounted: Yes; Socket: No; SMD: No; PressFit: Yes; Sense: No; Status: None; Manufacturer: AMPHENOL; Manufacturer Part Number: 10052829-101LF; ComponentHeight: 10.85mm; HelpURL: \\cern.ch\dfs\Applications\Altium\Datasheets\AMPHENOL_10052829-101LF.pdf; ComponentLink1URL: \\cern.ch\dfs\Applications\Altium\Datasheets\AMPHENOL_10052829-101LF_Application.pdf; ComponentLink1Description: Application; Author: CERN DEM MR; CreateDate: 30.04.2019; LatestRevisionDate: 30.04.2019
J2-J4 = AMPHENOL_10052842-101LF: 96 Contacts Receptacle, 8 Columns, 4 Pairs per Column; Part Description: 96 Contacts, 2mm Pitch, 8 Columns, 4 Pairs per Column, Vertical Receptacle; Part Number: AMPHENOL_10052842-101LF; Component Kind: Standard; Component Type: Standard; Pin Count: 96; Family: AirMax VS; Mounted: Yes; Socket: No; SMD: No; PressFit: Yes; Sense: No; Status: None; Manufacturer: AMPHENOL; Manufacturer Part Number: 10052842-101LF; ComponentHeight: 10.85mm; HelpURL: \\cern.ch\dfs\Applications\Altium\Datasheets\AMPHENOL_10052842-101LF.pdf; ComponentLink1URL: \\cern.ch\dfs\Applications\Altium\Datasheets\AMPHENOL_10052842-101LF_Application.pdf; ComponentLink1Description: Application; Author: CERN DEM MR; CreateDate: 30.04.2019; LatestRevisionDate: 30.04.2019
NT1 NT2 = Net Tie: Part Description: Net Tie (2 Nets); Mounted: No; Part Number: Net Tie; Component Type: Net Tie; Pin Count: 2; Family: Net Tie; Socket: No; SMD: No; Sense: No; Status: None; ComponentHeight: 0mm; HelpURL: Undefined; Author: CERN DEM JLC; CreateDate: 22.03.2011; LatestRevisionDate: 22.03.2011; PackageDescription: 2 Plated Through Hole For Coaxial Cable Link: Hole Dia.=1.4mm Pad Dia.=2.5mm